# EasyEDA Pro project ProProject_Avaota Pi A_2024-03-25.epro, board 点位 (continued)
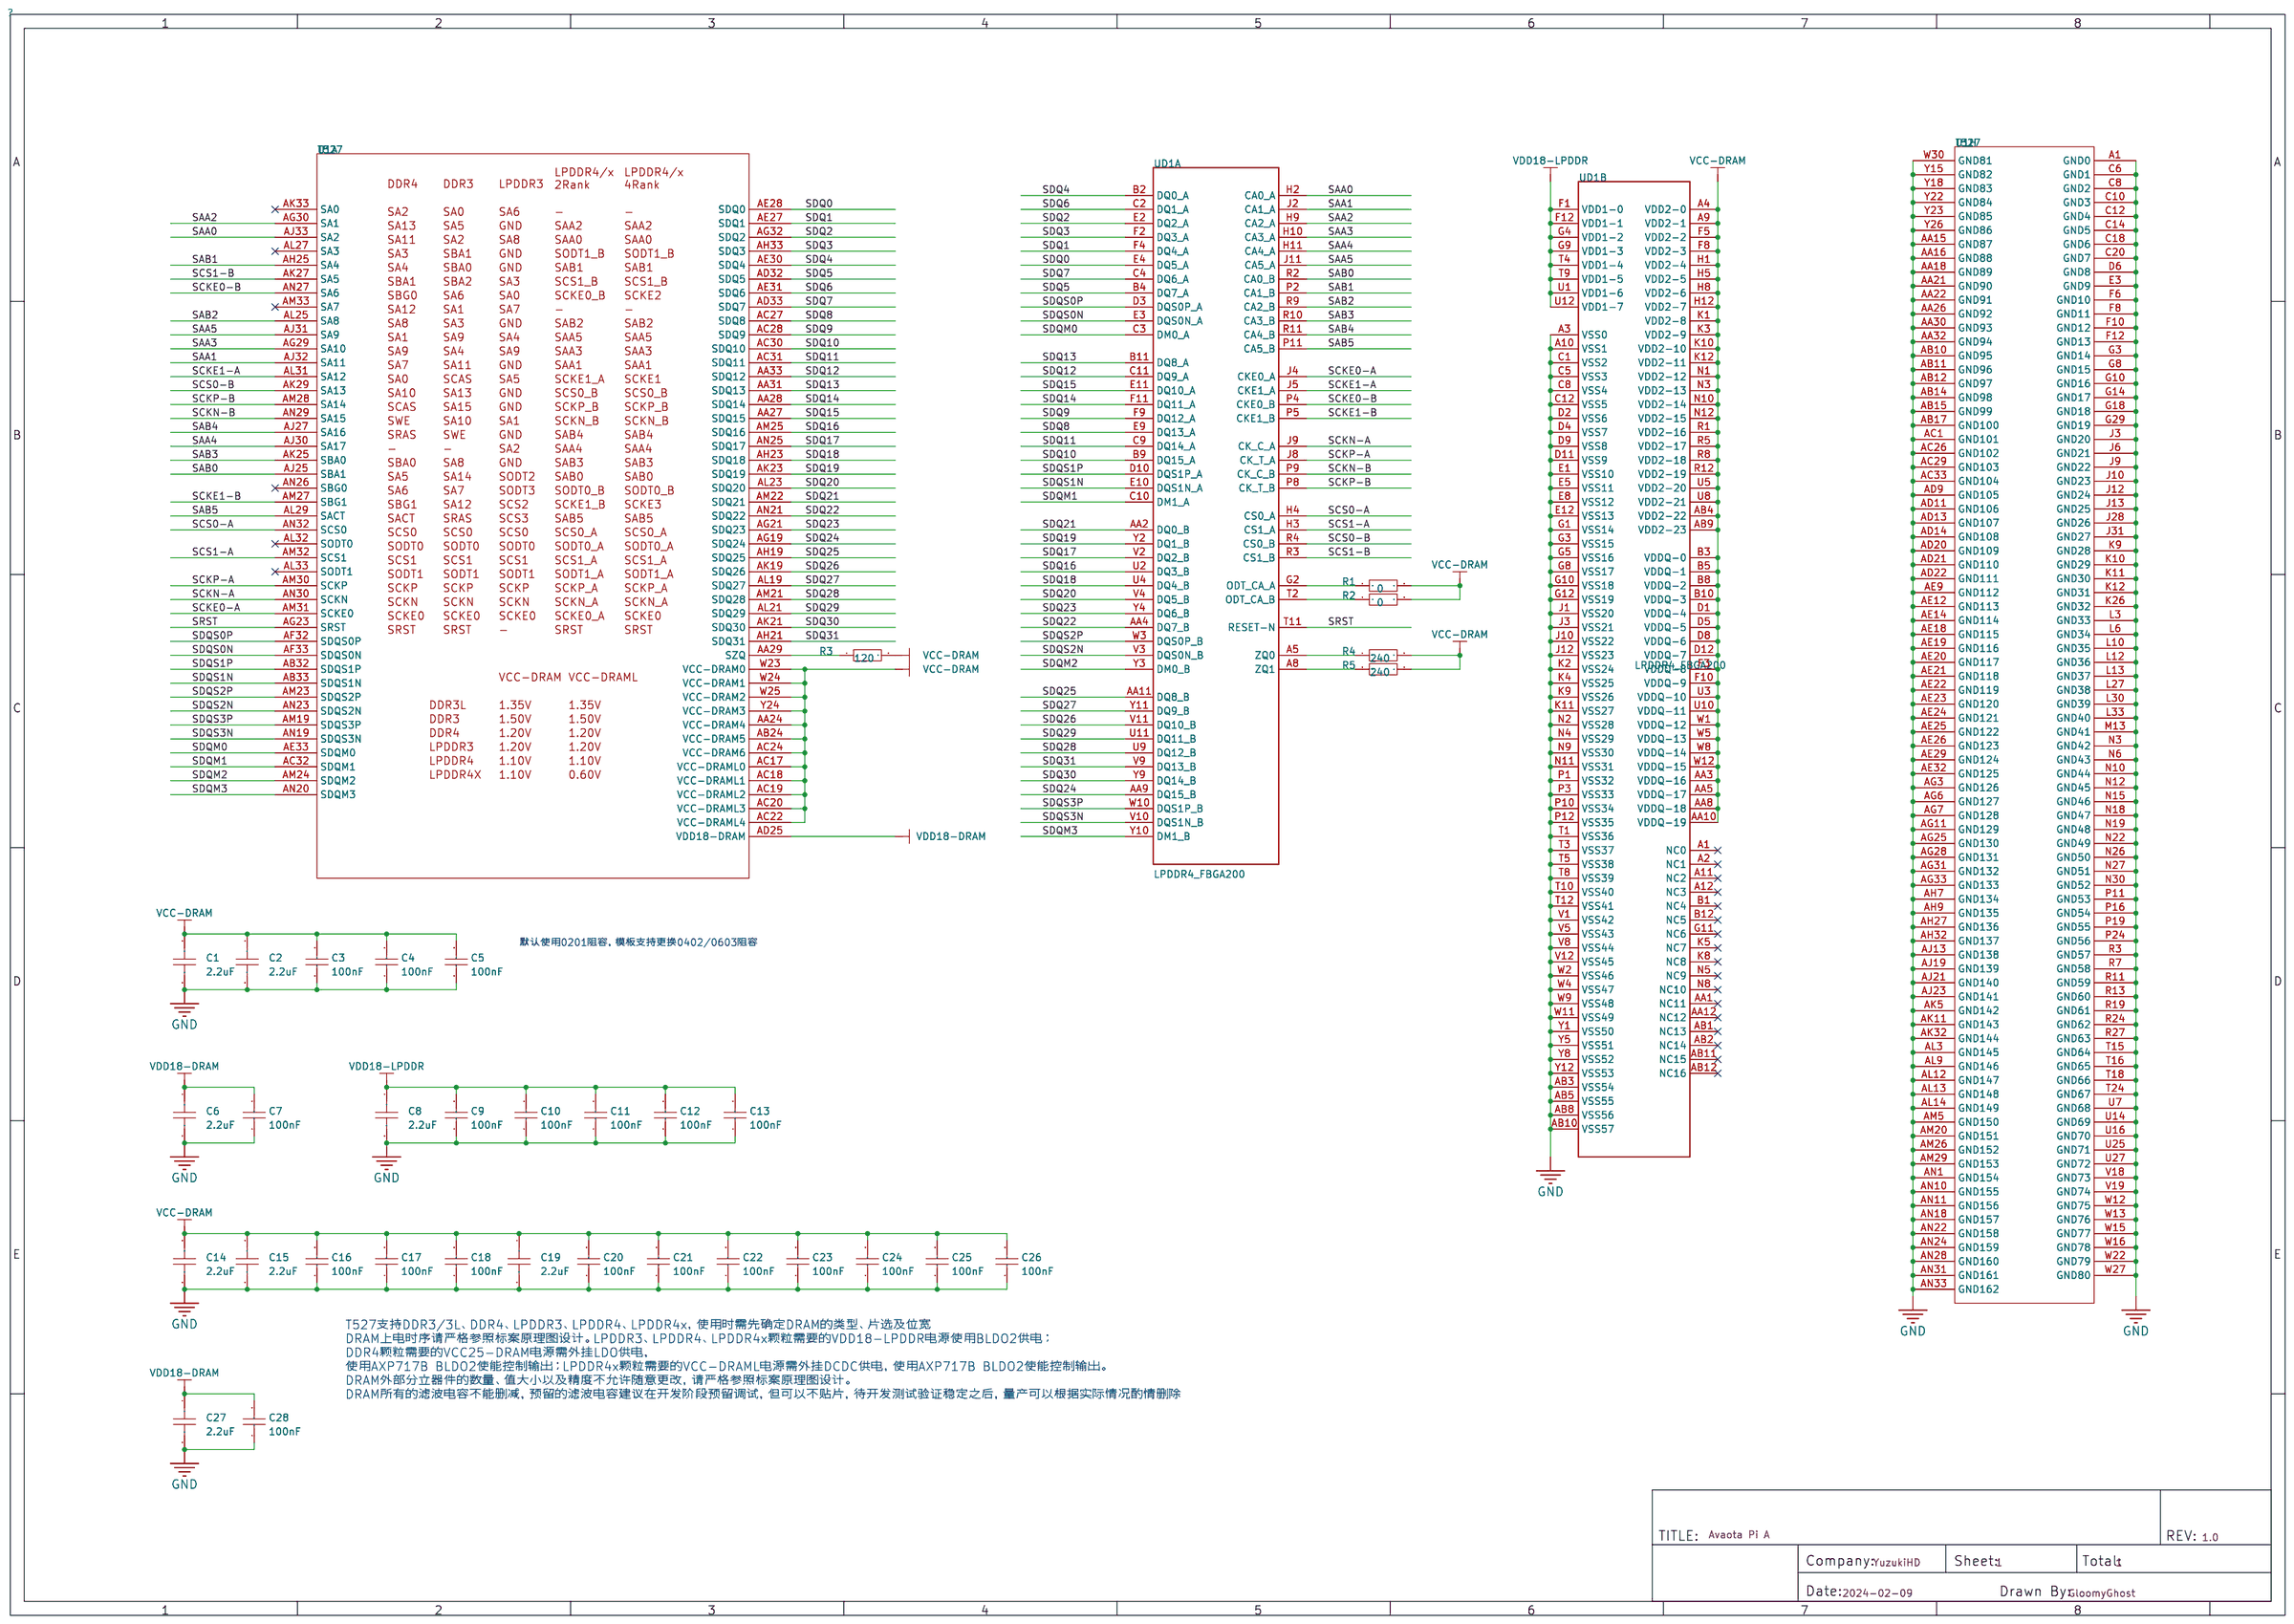
[diagram p0: schematic sheet]
## Routing (per net, layer and track width the routed paths; a pad name or vN(x,y) marks a point on that pad's centre or on a via; arc(x,y) is an arc through that point) (continued)
  vias: v2(40.18,43.31) v2(42.64,46.08) v2(58.43,47.14) v3(11.4,57.96) v3(11.38,57.28) v3(11.86,57.28) v3(11.86,56.72) v3(11.89,57.96) v3(12.37,57.25)
DCDC4: length 410.5
  Top Layer w0.102: R106.1 R110.2 79.65,23.99 ; R99.2 R102.2 79.67,23.98 79.65,23.99 ; v3(78.59,23.98) 79.13,23.98 C271.1 79.65,23.99 ; U13.40 81.88,20.49 81.79,20.4 81.79,19.89 81.08,19.18 v3(80.82,19.18) 80.39,18.75 C269.1
  Top Layer w0.127: C262.1 62.05,18.77 v1(63.37,20.09) 63.37,20.45 63.55,20.63 U12.40 ; R92.2 61.06,24.57 60.98,24.57 ; R92.2 61.07,24.66 ; R92.2 R84.2 R81.2 ; 60.98,24.57 61.07,24.66 ; 60.98,24.57 C263.1 ; 61.07,24.66 R88.1 ; R90.1 71.41,20.98 C264.1 69.98,20.45 69.8,20.63 U12.11
  Top Layer w0.152: U13.11 88.28,20.49 v3(88.49,20.27) 88.99,20.27 arc(89.14,20.41) 89.31,20.55 arc(89.44,20.68) R108.1 ; v3(62.94,52.58) U14.P9
  Top Layer w0.203: C250.1 v3(65.13,25.98) 65.2,25.91 U12.29 ; 83.36,24.79 83.36,25.61 83.19,25.78 83.19,26.51 C258.1
  Top Layer w0.254: v3(94.06,17.63) 94.1,17.59 R124.2 R125.2 ; v1(1.96,36.88) 2.05,36.78 v1(4.42,36.78) ; U14.K19 64.94,46.67 v1(64.95,46.66) ; v1(1.93,36.32) 4.37,36.32 v1(4.42,36.28) ; v1(91.41,38.36) v1(91.08,38.68) 91.08,39.19 90.55,39.73 89.48,39.73 88.68,40.53 88.68,44.36 89.26,44.93 v1(89.99,44.93) ; U14.L17 64.94,48.15 U14.J18 U14.J19 65.44,46.67 v1(65.46,46.66) ; v3(60.02,24.56) 60.47,24.56 C263.1 ; v3(4.78,56.72) R14.1 ; R61.1 50.19,25.31 v1(50.19,26.19)
  Top Layer w0.508: U9.9 v1(16.84,57.83)
  VCC w0.152: 3.25,56.79 4.7,56.79 v3(4.78,56.72)
  VCC w0.254: v3(94.06,17.63) 92.66,17.63 90.27,20.02 90.02,20.27 v3(88.49,20.27) ; v3(83.25,25.72) 82.37,24.84 82.22,24.84 ; 50.18,23.44 50.19,23.45 v1(50.19,26.19) ; v1(70.21,20.42) 70.1,20.32 64.47,20.32 64.03,20.75
  VCC w0.381: v1(65.46,46.66) 65.43,46.63 65.43,41.53 65.02,41.12 ; v3(62.94,52.58) 62.94,52.2 63.09,52.04 64.24,52.04 v1(64.39,52.2) 64.95,51.64 v1(64.95,46.66) 64.95,44.15 v3(64.44,43.65) 64.44,43.64 64.44,41.45 64.67,41.22
  VCC w0.508: 15.01,68.71 15.88,67.84 15.88,58.79 v1(16.84,57.83) ; 52.39,18.73 52.83,19.17 52.83,23.34 52.73,23.44
  VCC w0.762: v1(63.37,20.09) 64.03,20.75 64.03,23.62 63.03,24.62 62.69,24.62 ; 82.32,20.68 v3(80.82,19.18) ; 82.32,20.68 82.91,20.09 88.5,20.09 ; 82.32,20.68 82.32,23.88 81.59,24.61 ; 62.69,24.62 64.05,25.98 v3(65.13,25.98) 76.66,25.98 78.59,24.05 v3(78.59,23.98) ; 62.69,24.62 62.63,24.56 v3(60.02,24.56) ; 70.38,26.21 70.76,26.59 70.76,28.55 65.73,33.59 65.73,40.12 64.74,41.1 ; 78.13,24.71 82.24,24.71 ; 87.71,20.02 90.75,20.02 92.53,21.79 92.53,37.24 v1(91.41,38.36) v1(91.08,38.68)
  VCC w1.27: 28.22,70.69 26.14,68.61 5.82,68.61 ; 3.25,53.14 3.25,66.04 5.82,68.61 ; v3(60.02,24.56) 58.9,23.44 48.74,23.44 46.38,25.81 40.11,25.81 38.53,24.23 32.33,24.23 26.19,18.09 6.07,18.09 2.01,22.15 2.01,51.56 3.46,53.01 v3(3.56,53.01) ; 5.82,68.61 7.9,70.69
  内层4 w0.381: v1(57.44,48.65) 58.62,48.65 58.93,48.34 58.93,46.18 59.46,45.64 60.68,45.64 61.24,45.09 62.84,45.09 64.41,46.66 v1(64.95,46.66)
  Bottom Layer w0.254: C223.2 53.19,21.19 52.73,20.73 ; U11.5 C204.2 98.59,16.93 98.32,16.66 95.02,16.66 ; RJ2.14 90.84,2.69 ; 90.84,2.69 91.54,2.69 95.35,6.5 95.35,16.33 95.02,16.66 ; 90.84,2.69 80.05,2.69 78.84,1.48 78.55,1.78 74.06,1.78 RJ1.14 72.29,3 62.07,3 RJ1.11 ; 65.31,46.89 65.46,46.75 v1(65.46,46.66) C176.2 ; v3(64.44,43.65) 64.44,43.64 C169.2 ; 93.34,29.85 93.46,29.96 FPC2.4 ; 93.34,29.85 v1(92.74,29.85) ; 93.34,29.85 92.96,29.46 ; FPC1.3 5.51,36.78 v1(4.42,36.78) ; FPC2.2 92.91,28.96 92.68,29.18 92.96,29.46 ; FPC1.4 v1(4.42,36.28) ; 52.73,20.73 52.73,19.07 52.39,18.73 ; 52.73,20.73 52.4,21.05 C224.2 ; C177.2 57.89,48.65 v1(57.44,48.65) ; 95.02,16.66 v3(94.06,17.63) ; v1(89.99,44.93) 90.07,44.93 90.45,45.31 90.45,48.11 88.72,49.84 U16.5 89.19,50.53 C276.1 ; FPC2.3 92.96,29.46 ; v1(64.39,52.2) 64.44,52.25 C170.2 ; C175.2 64.92,46.63 v1(64.95,46.66) 64.93,46.68 C167.2
  vias: v1(92.74,29.24) v3(3.56,53.54) v3(4.09,53.54) v3(4.11,53.04) v3(4.6,53.52)
DCIN-5V: length 9.1
  Top Layer w0.254: D3.1 7.74,43.18 9.77,41.15 13.08,41.15 14.22,40.01 R3.2
DCIN-12V: length 7.5
  Top Layer w0.254: 11.99,30.28 U3.2 12.12,30.63 12.52,30.63 12.65,30.51 12.65,29.79 12.9,29.54 12.9,29.36 13.33,28.93 14.33,28.93 14.58,28.68 14.58,27.91 14.81,27.69 16.03,27.69 16.19,27.85 R4.2
DCXO-XIN: length 5.7
  Top Layer w0.102: U14.AM13 53.64,50.44 53.21,50.44 53.11,50.34 51.09,50.34 C99.2 50.44,50.36 49.56,50.36 49.02,50.9 X1.1
DCXO-XOUT: length 3.7
  Top Layer w0.102: U14.AN13 51.12,50.15 C98.2 50.35,49.8 X1.3
DDR-PARA-SEL-ADC1: length 4.3
  Top Layer w0.076: 60.44,55.64 60.44,55.79 60.69,56.04 60.69,56.23 60.55,56.42 60.36,56.46 60.18,56.9 60.09,57.34
  Top Layer w0.102: 60.1,57.35 60.1,58.5 59.79,58.8 R31.1 R34.2
DDR-PARA-SEL-ADC2: length 6.2
  Top Layer w0.076: 60.44,55.14 60.19,55.39 60.18,55.85 59.82,56.37 59.64,57.21 59.64,57.21
  Top Layer w0.102: R32.1 R35.2 57.9,58.55 58.55,58.55 58.8,58.29 59.41,58.29 59.59,58.12 59.59,57.26 59.64,57.21 59.64,57.2
DSP-UART-RX: length 19.9
  Bottom Layer w0.102: H1.40 56.16,73.1 54.91,71.86 54.91,69.95 54.15,69.19 54.15,61.6 52.27,59.72 52.27,58.22 52.4,58.09 52.4,57.34 52.92,56.82 53.26,56.82 53.49,56.59 53.49,55.73 v1(53.44,55.68)
DSP-UART-TX: length 17.5
  Top Layer w0.102: v1(51.94,57.76) 51.94,57.07 52.65,56.36 52.65,55.42 52.93,55.15 U14.AN3
  Bottom Layer w0.102: 53.87,64.66 53.87,70.43 53.62,70.69 ; 53.87,64.66 53.87,64.74 ; 53.87,64.66 53.87,61.77 51.94,59.84 v1(51.94,57.76)
EDP-AUXN: length 41.7
  Top Layer w0.076: 68.44,40.14 68.49,40.1 68.49,39.94 69.6,38.83 69.6,38.58 70.05,38.13 70.05,38.1
  Top Layer w0.127: 70.05,38.1 73.25,34.9 73.25,34.4 74.24,33.41 74.24,30.96 72.87,29.59 62.64,29.59 59.14,26.09 v3(58.93,26.09) ; v3(49.66,25.82) 49.56,25.72 49.56,25.44 C199.1
  内层2 w0.127: v3(49.66,25.82) 49.45,25.62 49.45,25.4 49.58,25.27 49.89,25.27 50.02,25.4 50.02,25.68 50.15,25.81 50.27,25.81 50.4,25.68 50.4,25.4 50.53,25.27 50.66,25.27 50.78,25.4 50.78,25.68 50.91,25.81 51.04,25.81 51.16,25.68 51.16,25.4 51.29,25.27 52.04,25.27 52.29,25.03 58.08,25.03 58.93,25.88 v3(58.93,26.09)
EDP-AUXP: length 41.5
  Top Layer w0.076: 68.44,40.64 68.69,40.39 68.69,40.04 68.68,40.03 68.68,40 69.82,38.85 69.82,38.65 70.22,38.26
  Top Layer w0.127: 70.22,38.26 73.48,34.99 73.48,34.49 74.47,33.5 74.47,30.87 72.99,29.39 62.76,29.39 59.26,25.88 v3(59.26,25.68) ; C198.1 49.23,25.44 49.23,25.72 v3(49.12,25.82)
  内层2 w0.127: v3(59.26,25.68) 59.23,25.71 59.08,25.71 58.17,24.8 52.19,24.8 52,24.99 49.51,24.99 49.22,25.28 49.22,25.72 v3(49.12,25.82)
EDP-HPD: length 41.8
  Top Layer w0.127: v3(67.93,42.15) U14.C29 ; v3(51.1,26.24) 51.09,26.23 51.09,25.32 ; 51.09,25.32 50.95,25.32 50.64,25.01 D12.4 v3(50.64,22.2) ; 51.09,25.32 R60.2
  内层2 w0.127: v3(67.93,42.15) 69.61,42.15 70.51,41.25 70.51,38.35 66.85,34.7 66.85,33.4 66.32,32.87 57.73,32.87 v3(51.1,26.24)
  Bottom Layer w0.127: v3(50.64,22.2) 50.5,22.06 50.5,19.46 50.9,19.05 51.1,19.05 51.56,18.59 51.56,17.93 52.06,17.43 52.39,17.43
EDP-TX0N: length 39.1
  Top Layer w0.076: 68.94,42.14 69.19,41.89 70.43,41.89 71.21,41.11
  Top Layer w0.102: C196.1 52.4,25.46 52.4,25.68 v3(52.53,25.81)
  Top Layer w0.127: v3(75.82,37.39) 75.66,37.39 74.72,38.33 74,38.33 71.21,41.11
  内层2 w0.127: v3(75.82,37.39) 75.66,37.39 75.26,37.8 71.4,37.8 67.72,34.11 67.72,32.79 67.03,32.11 58.19,32.11 52.38,26.29 52.38,26.22 52.53,26.07 v3(52.53,25.81)
EDP-TX0P: length 39.1
  Top Layer w0.076: 71.37,41.28 70.58,42.07 69.51,42.07 69.44,42.14
  Top Layer w0.102: C197.1 52.12,25.45 52.12,25.68 v3(51.99,25.81)
  Top Layer w0.127: 71.37,41.28 74.09,38.56 74.9,38.56 75.56,37.9 v3(75.84,37.9)
  内层2 w0.127: v3(51.99,25.81) 51.99,26.07 52.15,26.22 52.15,26.38 52.28,26.52 52.28,26.7 52.46,26.88 52.64,26.88 52.82,27.06 52.82,27.24 53,27.42 53.18,27.42 53.36,27.6 53.36,27.78 53.54,27.95 53.72,27.95 53.9,28.13 53.9,28.31 54.08,28.49 54.26,28.49 58.1,32.33 66.93,32.33 67.49,32.89 67.49,34.21 71.3,38.02 75.44,38.02 75.56,37.9 v3(75.84,37.9)
EDP-TX1N: length 37.7
  Top Layer w0.076: 68.94,41.64 69.18,41.4 70.1,41.4 70.33,41.17 70.33,41.15
  Top Layer w0.127: 70.33,41.15 71.68,39.8 71.68,39.47 73.71,37.44 74.25,37.44 75.36,36.33 v3(75.36,36.12) ; C194.1 53.85,25.48 53.85,25.71 v3(54,25.86) 53.91,25.86
  内层2 w0.127: v3(75.36,36.12) 75.36,36.35 74.75,36.96 71.7,36.96 68.55,33.81 68.55,32.23 67.51,31.19 58.62,31.19 53.86,26.43 53.86,26.26 54,26.12 v3(54,25.86)
EDP-TX1P: length 37.6
  Top Layer w0.076: U14.A30 69.48,41.61 70.21,41.61 70.51,41.3
  Top Layer w0.127: C195.1 53.62,25.45 53.62,25.73 v3(53.49,25.86) ; v3(75.72,36.51) 75.51,36.51 74.35,37.67 73.81,37.67 71.91,39.57 71.91,39.9 70.51,41.3
  内层2 w0.127: v3(75.72,36.51) 75.52,36.51 74.85,37.19 71.61,37.19 68.33,33.9 68.33,32.33 67.41,31.42 58.53,31.42 53.63,26.52 53.63,26.26 53.49,26.12 v3(53.49,25.86)
EDP-TX2N: length 35.8
  Top Layer w0.076: 68.94,41.14 69.07,41.14 69.32,40.89 69.9,40.89 70.76,40.03 70.76,40.01
  Top Layer w0.127: v3(74.96,34.95) 74.96,35.12 70.99,39.08 70.99,39.78 70.76,40.01 ; C192.1 55.25,25.43 55.25,25.71 v3(55.37,25.83)
  内层2 w0.127: v3(74.96,34.95) 74.96,35.1 73.91,36.14 71.95,36.14 69.37,33.56 69.37,31.7 67.97,30.3 59.11,30.3 55.21,26.41 55.21,26.24 55.37,26.08 v3(55.37,25.83)
EDP-TX2P: length 35.8
  Top Layer w0.076: 69.44,41.14 69.51,41.07 70.02,41.07 70.93,40.17
  Top Layer w0.127: v3(75.26,35.38) 75.02,35.38 71.22,39.18 71.22,39.87 70.93,40.17 ; C193.1 54.94,25.43 54.94,25.73 v3(54.81,25.86)
  内层2 w0.127: v3(75.26,35.38) 75,35.38 74.01,36.37 71.86,36.37 69.14,33.66 69.14,31.83 67.84,30.53 59.01,30.53 54.98,26.5 54.98,26.24 54.81,26.07 v3(54.81,25.86)
EDP-TX3N: length 35.5
  Top Layer w0.076: 68.94,40.14 69.01,40.07 69.01,39.97 69.33,39.65 69.58,39.65 69.7,39.52 69.88,39.52 69.98,39.62 70.31,39.62 70.41,39.52 70.41,39.4
  Top Layer w0.127: v3(75.1,32.34) 75.1,32.57 74.81,32.87 74.81,33.79 73.91,34.68 73.91,35.1 70.41,38.61 70.41,39.4 ; v3(56.87,25.83) 56.74,25.71 56.74,25.43 C190.1
  内层2 w0.127: v3(56.87,25.83) 56.87,26.05 56.71,26.21 56.71,26.58 59.56,29.44 72.75,29.44 74.55,31.24 74.55,31.46 74.68,31.59 75.11,31.59 75.23,31.71 75.23,31.84 75.11,31.97 74.68,31.97 74.55,32.1 74.55,32.46 74.83,32.74 75.03,32.74 75.16,32.61 75.16,32.39 v3(75.1,32.34)
EDP-TX3P: length 35.3
  Top Layer w0.076: 70.64,39.4 70.64,39.55 70.59,39.6 70.59,39.6 70.36,39.83 69.4,39.83 69.19,40.04 69.19,40.25 69.19,40.25 69.19,40.39 68.94,40.64
  Top Layer w0.127: C191.1 56.44,25.43 56.44,25.73 v3(56.34,25.83) ; v3(75.52,32.71) 75.28,32.71 75.04,32.96 75.04,33.88 74.14,34.77 74.14,35.2 70.64,38.7 70.64,39.4
  内层2 w0.127: v3(75.52,32.71) 75.39,32.71 75.11,32.99 74.73,32.99 74.29,32.56 74.29,31.31 72.65,29.67 59.47,29.67 56.48,26.68 56.48,26.21 56.34,26.07 v3(56.34,25.83)
EMMC-VDDI: length 3.1
  Top Layer w0.102: v3(42.24,36.5) 41.91,36.17 41.91,35.63 U8.C2
  Bottom Layer w0.254: C232.2 C231.1 ; C232.2 42.47,36.73 v3(42.24,36.5) ; C232.2 C233.2
FEL: length 88.8
  Top Layer w0.127: U14.F16 v3(66.94,49.15)
  内层2 w0.152: v1(0.84,51.69) 2.01,52.86 2.01,58.22 4.27,60.48 14.91,60.48 16.15,59.23 v1(19.08,59.23)
  VCC w0.152: v1(19.08,59.23) 20.19,59.23 22.35,57.07 24.77,57.07 30.63,62.94 47.45,62.94 49.89,60.5 58.42,60.5 58.72,60.81 59.64,60.81 60.22,60.22 60.22,57.38 61.7,55.91 63.6,55.91 64.41,55.09 64.41,52.98 65.48,51.92 65.48,50.34 66.67,49.15 v3(66.94,49.15)
  Bottom Layer w0.152: R22.2 2.52,51.7 C96.2 0.85,51.7 v1(0.84,51.69)
GM0_DVDD10: length 28.4
  Top Layer w0.127: 67.6,19.93 v3(67.6,19.18) 67.6,18.72 C266.1 ; 61.58,19.96 61.68,19.86 62.08,19.86 62.66,20.45 62.66,21.01 v3(62.86,21.21) 63.08,21.43 U12.38 ; C267.1 v3(65.58,19.15) 65.58,19.91 U12.3 ; U12.21 68.4,25.32 69.8,26.72 v3(69.8,26.73)
  Bottom Layer w0.584: v3(69.8,26.73) 69.8,26.47 68.22,24.89 65.1,24.89 64.16,23.95 ; 64.11,21.67 63.64,21.21 v3(62.86,21.21) ; 64.11,21.67 64.11,23.85 61.87,26.09 v3(61.87,26.39) v3(61.87,26.95) ; 64.11,21.67 64.11,21.41 65.58,19.94 ; v3(67.6,19.18) 66.84,19.94 65.58,19.94 ; 65.58,19.94 v3(65.58,19.15)
GM0_INTB: length 2.9
  Top Layer w0.102: U12.31 63.5,24.23 62.99,24.74 62.66,24.74 62.31,25.1 61.58,25.1 61.56,25.12
GM0_LED0: length 2.8
  Top Layer w0.102: U12.32 63.37,23.83 62.81,24.38 62.34,24.38 62.2,24.52 62.17,24.56 61.56,24.56
GM0_LED1: length 24.1
  Top Layer w0.102: 62.17,24 R87.1 ; 62.17,24 61.56,24 ; 62.17,24 62.56,24 v1(62.84,23.72) 63.13,23.43 U12.33
  Top Layer w0.152: R94.2 v1(57.99,6.2) R80.2
  内层4 w0.152: v1(62.84,23.72) 62.84,23.42 62.38,22.96 61.14,22.96 57.48,19.3 57.48,6.7 v1(57.99,6.2)
GM0_LED2: length 23.5
  Top Layer w0.127: U12.34 62.7,23.03 v1(62.31,23.42) 61.58,23.42 61.56,23.39
  Top Layer w0.152: R79.1 v1(57.4,6.19) R96.2
  内层4 w0.152: v1(62.31,23.42) 62.15,23.27 60.91,23.27 57.12,19.48 57.12,6.47 v1(57.4,6.19)
GM0_MDIN0: length 8.5
  Top Layer w0.127: RJ1.P3 64,14.47 63.81,14.28 63.22,14.28 62.81,14.68 62.81,16.31 65.11,18.61 65.11,19.38 65.2,19.47 U12.2
GM0_MDIN1: length 14.3
  Top Layer w0.127: RJ1.P7 69.08,12.57 68.25,11.74 67.21,11.74 66.55,12.4 66.55,13.49 65.41,14.63 65.41,16.34 66.31,17.25 66.31,19.38 66.4,19.47 U12.5
GM0_MDIN2: length 7.8
  Top Layer w0.127: U12.7 67.2,19.47 67.11,19.38 67.11,17.06 67.86,16.32 67.86,14.58 67.37,14.09 67.37,13.15 RJ1.P6
GM0_MDIN3: length 8.4
  Top Layer w0.127: RJ1.P9 71.62,14.4 71.5,14.28 70.97,14.28 70.38,14.86 70.38,17.25 68.31,19.32 68.31,19.38 68.4,19.47 U12.10
GM0_MDIP0: length 8.5
  Top Layer w0.127: RJ1.P2 63.06,13.23 63.06,14.11 62.59,14.59 62.59,16.41 64.88,18.71 64.88,19.38 64.8,19.47 U12.1
GM0_MDIP1: length 14.3
  Top Layer w0.127: RJ1.P4 65.23,12.75 65.23,10.9 65.63,10.49 66.57,10.49 67.06,10.97 67.06,11.53 66.32,12.27 66.32,13.39 65.18,14.54 65.18,16.43 66.08,17.34 66.08,19.38 66,19.47 U12.4
GM0_MDIP2: length 7.8
  Top Layer w0.127: RJ1.P5 66.73,15.16 66.73,14.38 66.85,14.25 67.21,14.25 67.63,14.67 67.63,16.22 66.88,16.97 66.88,19.38 66.8,19.47 U12.6
GM0_MDIP3: length 8.5
  Top Layer w0.127: U12.9 68,19.47 68.08,19.38 68.08,19.22 70.15,17.15 70.15,14.76 70.82,14.1 70.82,13.74 70.25,13.18 RJ1.P8
GM0_RSET: length 3.5
  Top Layer w0.127: U12.39 63.23,21.03 63.02,20.82 63.02,20.32 62.26,19.56 61.76,19.56 R85.2
GM0_XTAL_IN: length 4.2
  Top Layer w0.127: X3.1 60.48,22.25 61.06,21.67 61.8,21.67 C252.2 63.3,22.07 63.45,22.23 U12.36
GM0_XTAL_OUT: length 3
  Top Layer w0.127: X3.3 61.82,21.21 C251.2 62.7,21.7 63.46,21.7 63.59,21.83 U12.37
GM1_DVDD10: length 26.2
  Top Layer w0.102: C273.1 80.23,19.91 80.85,19.91 81.15,20.22 81.15,20.7 81.74,21.29 U13.38
  Top Layer w0.127: C272.1 v3(85.78,19.11) 85.78,19.77 U13.8 ; C275.2 83.77,18.72 v3(83.77,19.13) 83.77,19.78 U13.3
  Top Layer w0.152: 87.68,26.56 86.56,25.43 86.56,24.79
  Bottom Layer w0.254: v3(86.69,25.5) arc(86.25,25.08) 85.8,24.66
  Bottom Layer w0.635: v3(85.78,19.11) 84.8,20.09 82.8,20.09 ; v3(80.06,26.62) v3(80.06,26.15) 82.45,23.76 ; 82.45,23.76 82.45,20.45 ; 82.45,23.76 83.35,24.66 85.8,24.66 ; 82.45,20.45 82.8,20.09 ; 82.45,20.45 81.79,20.45 v3(81.31,20.93) ; 82.8,20.09 v3(83.77,19.13)
GM1_DVDDRG: length 382.5
  Top Layer w0.102: R101.1 89.74,21.91 v3(89.74,21.97)
  Top Layer w0.127: v3(71.96,21.9) 71.91,21.84 R83.1 ; R47.1 34.66,18.99 30.81,22.83 v1(28.96,22.83)
  Top Layer w0.152: v3(67.31,27.69) 67.31,27.27 67.34,27.24
  Top Layer w0.178: R109.2 87.07,27.33 87.38,27.64 88.01,27.64 88.34,27.31 88.34,25.88 88.67,25.55 90.09,25.55 90.53,25.12 90.53,24.28 89.74,23.5 v3(89.74,21.97) ; v3(83.85,28.58) 84.28,28.58 85.37,27.48 R107.2
  Top Layer w0.203: 83.77,26.47 83.67,26.37 83.67,25.93 v3(83.76,25.84) 83.76,24.79 ; U4.26 12.04,54.43 12.67,55.07 v1(12.92,55.07) ; U12.28 65.6,25.92 65.63,25.96 v3(65.63,26.71)
  Top Layer w0.254: 40.58,33.3 U8.J10 U8.K9 ; 40.58,33.3 40.58,33.48 U8.F5 39.6,33.32 v1(39.6,33.17) ; 40.58,33.3 U8.E6 ; 69.19,27.24 69.19,27.46 69.01,27.64
  VCC w0.254: v1(56.73,65.81) 57.8,66.88 62.56,66.88 63.7,68.02 67.13,68.02 68.71,69.6 76.2,69.6 78.54,71.93 91.69,71.93 95.17,68.45 97.05,68.45 97.54,67.97 97.54,64.95 97.16,64.57 97.16,52.69 v3(96.11,51.65)
  VCC w0.381: v3(58.44,52.15) 57.94,52.65 57.94,53.62 57.4,54.15 57.4,55.56 56.93,56.03 54.18,56.03 53.34,56.87 52.12,56.87 47.52,61.47 29.87,61.47 24.23,55.83 14,55.83 13.23,55.07 v1(12.92,55.07)
  VCC w0.508: v3(96.11,51.65) 95.68,51.22 95.68,44.76 90.2,39.27 90.2,38.18 91.54,36.83 91.54,29.57 90.55,28.58 v3(83.85,28.58) 83.44,28.17 v1(82.25,28.17) ; 41.15,27.36 39.57,27.36 37.95,25.73 31.85,25.73 v1(28.96,22.83) 25.6,19.48 6.78,19.48 3.1,23.17 3.1,50.98 5.36,53.24 5.36,54.48 7.05,56.18 11.8,56.18 v1(12.92,55.07)
  VCC w0.635: v1(39.6,33.17) 39.6,28.91 41.15,27.36 41.66,27.86 59.41,27.86 ; 59.41,27.86 59.59,27.86 ; 59.41,27.86 63.65,27.94 64.13,27.46 67.08,27.46 v3(67.31,27.69)
  Inner5 w0.457: 60.35,51 60.12,51.23 59.36,51.23 v3(58.44,52.15) ; 60.45,50.98 61.29,50.14 62.31,50.14 62.46,49.99 63.07,49.99 63.96,49.1 v1(64.44,49.1)
  Bottom Layer w0.152: v1(39.6,33.17) 40,32.77 C229.2 C235.2 ; v1(95.72,46.76) C228.1 C234.1
  Bottom Layer w0.254: v1(39.6,33.17) 39.4,32.97 C230.2 ; R75.2 v1(56.73,65.81) 57.19,66.27 57.38,66.27 ; SIM1.4 98.56,58.81 96.88,57.12 96.88,56.01 96.11,55.25 v3(96.11,51.65) D20.1 ; 57.38,66.27 57.96,66.85 63.02,66.85 64.57,68.4 65.33,68.4 65.57,68.16 R73.2 65.57,67.4 66.78,66.19 R74.2 ; 57.38,66.27 57.49,66.27 ; 57.38,66.27 57.28,66.17 ; v1(64.44,49.1) 64.39,49.15 C173.2 C174.2 ; 65.61,27.23 65.63,27.2 v3(65.63,26.71) ; C102.2 58.44,52.15
  Bottom Layer w0.381: v3(83.76,25.84) 83.77,25.83 86,25.83 86.28,26.11 86.94,26.11 87.27,25.78 87.27,24.56 88.01,23.83 89.41,23.83 89.89,23.34 89.89,22.12 v3(89.74,21.97)
  Bottom Layer w0.635: 71.91,21.9 69.77,21.9 69.16,22.5 69.16,24.74 70.56,26.14 70.56,27.05 69.93,27.69 ; 69.93,27.69 76.94,27.69 77.42,28.17 v1(82.25,28.17) 83.44,28.17 v3(83.85,28.58) 86.77,28.58 87.88,27.46 87.88,26.39 87.32,25.83 ; 69.93,27.69 v1(69,27.69) v3(67.31,27.69) 66.04,27.69 65.66,27.31
GM1_INTB: length 2.3
  Top Layer w0.102: 82.26,24.09 81.68,24.09 81.23,24.54 R106.2
GM1_LED0: length 2.2
  Top Layer w0.102: R110.1 80.16,23.99 R105.2 81.22,23.99 81.52,23.69 U13.32
GM1_LED1: length 27.1
  Top Layer w0.102: 82.26,23.29 v1(81.41,23.29) 81.23,23.47 80.78,23.47 R105.1 80.72,23.48 R102.1
  Top Layer w0.152: v3(76.3,8.1) 76.94,7.47 76.94,6.63 76.65,6.34 R112.2 R98.2
  内层2 w0.152: v3(76.3,8.1) 75.95,7.75 74.68,7.75 73.43,8.99 73.43,10.36 74.32,11.25 75.72,11.25 76.71,12.24 76.71,18.47 80.77,22.53 80.95,22.53 81.41,22.99 v1(81.41,23.29)
GM1_LED2: length 25.4
  Top Layer w0.102: U13.34 81.28,22.89 81.13,23.04 v1(80.82,23.04) 80.2,23.04 R99.1
  Top Layer w0.152: v3(75.64,7.31) 75.54,7.21 75.54,6.5 75.7,6.34 R114.2 R97.1
  内层2 w0.152: v3(75.64,7.31) 75.54,7.42 74.52,7.42 73.15,8.79 73.15,10.54 74.24,11.63 75.56,11.63 76.35,12.42 76.35,18.57 v1(80.82,23.04)
GM1_MDIN0: length 8.7
  Top Layer w0.127: 82.27,15.33 82.45,15.14 82.45,14.38 82.27,14.2 81.64,14.2 81.1,14.73 81.1,16.44 83.27,18.61 83.27,19.24 83.36,19.33 U13.2
GM1_MDIN1: length 14.1
  Top Layer w0.127: U13.5 84.54,19.78 84.54,17.22 84.43,17.11 ; 84.43,17.11 83.7,16.38 83.7,14.68 84.85,13.53 84.85,12.44 85.51,11.78 86.55,11.78 86.98,12.21 86.98,14.96 RJ2.P7 ; 84.43,17.11 84.5,17.18
GM1_MDIN2: length 7.8
  Top Layer w0.127: U13.7 85.36,19.26 85.3,19.2 85.3,17.21 86.18,16.33 86.18,14.66 85.62,14.1 85.62,13.14 RJ2.P6
GM1_MDIN3: length 8.5
  Top Layer w0.127: 89.89,15.33 89.92,15.3 89.92,14.38 89.71,14.17 89.28,14.17 88.72,14.73 88.72,16.28 86.47,18.53 86.47,19.24 86.56,19.33 U13.10
GM1_MDIP0: length 8.5
  Top Layer w0.127: U13.1 82.96,19.33 83.04,19.24 83.04,18.7 80.87,16.54 80.87,14.64 81.56,13.95 81.56,13.44 80.91,12.79 RJ2.P2
GM1_MDIP1: length 14.1
  Top Layer w0.127: 83.53,12.8 83.47,12.85 ; RJ2.P4 83.44,11.03 83.93,10.54 84.87,10.54 85.35,11.02 85.35,11.58 84.62,12.31 84.62,13.44 83.47,14.58 83.47,16.48 84.31,17.32 84.31,19.18 84.16,19.33 U13.4
GM1_MDIP2: length 7.7
  Top Layer w0.127: U13.6 84.96,19.31 85.07,19.2 85.07,17.12 85.95,16.23 85.95,14.76 85.47,14.28 85.14,14.28 84.76,14.66 84.76,15.28 RJ2.P5
GM1_MDIP3: length 8.6
  Top Layer w0.127: RJ2.P8 88.58,12.79 89.18,13.39 89.18,13.95 88.49,14.64 88.49,16.19 86.24,18.44 86.24,19.24 86.16,19.33 U13.9
GM1_RSET: length 3.1
  Top Layer w0.102: R103.2 80.26,19.28 80.57,19.58 80.95,19.58 81.46,20.09 81.46,20.57 81.77,20.89 U13.39
GM1_XTAL_IN: length 3.9
  Top Layer w0.102: C259.2 80.92,21.64 81.23,21.64 81.68,22.09 82.26,22.09
  Top Layer w0.152: X4.1 79.71,21.46 80.39,21.46 C259.2
GM1_XTAL_OUT: length 2.8
  Top Layer w0.102: C257.2 80.75,21.18 80.92,21.36 81.38,21.36 81.71,21.69 U13.37
  Top Layer w0.152: C257.2 80.37,20.96 80.04,20.62
HBIAS: length 30.4
  Top Layer w0.203: U14.AL1 54.51,56.21 54.51,57.2 v3(54.71,57.4)
  内层2 w0.254: v3(63.96,69.55) 65.06,68.44 v3(71.78,68.44)
  GND2 w0.254: v3(54.71,57.4) 54.86,57.56 54.86,65.76 56.41,67.31 62.38,67.31 63.96,68.89 v3(63.96,69.55)
  Bottom Layer w0.127: R64.2 71.04,68.59 C237.2 v3(71.78,68.44)
HCEC: length 49.5
  Top Layer w0.102: U14.E28 v3(67.44,43.15)
  Top Layer w0.127: v3(40.36,23.11) 40.36,22.72 R48.1 38.95,22.7 38.56,22.3 D7.1
  Inner5 w0.127: v3(40.36,23.11) 41.28,24.03 42.11,24.03 42.54,24.46 43.64,24.46 43.97,24.79 44.4,24.79 47.45,27.84 59.31,27.84 60.27,28.8 64.59,28.8 68.12,32.33 68.12,33.99 70.54,36.4 70.54,42.14 70.28,42.39 69.8,42.39 69.42,42.77 67.82,42.77 v3(67.44,43.15)
HHPD: length 44.7
  Top Layer w0.102: v3(67.94,43.15) U14.D28
  Top Layer w0.127: R54.1 43.08,23.14 ; 43.08,23.14 44.27,24.33 v3(44.3,24.33) ; 43.08,23.14 C189.2
  Inner5 w0.127: v3(67.94,43.15) 69.55,43.15 69.93,42.77 70.43,42.77 70.92,42.29 70.92,36.17 68.5,33.76 68.5,32.06 64.85,28.4 60.48,28.4 59.51,27.43 47.7,27.43 44.6,24.33 v3(44.3,24.33)
HP-DET: length 25.9
  Top Layer w0.076: v3(55.07,57.05) 55.19,56.92 55.19,55.95 55.46,55.67
  Top Layer w0.152: v3(66.73,71.07) 68.06,72.41 CN2.3
  GND2 w0.152: v3(55.07,57.05) 55.27,57.25 55.27,65.56 56.67,66.95 62.61,66.95 v3(66.73,71.07)
HPOUTFB: length 42.5
  Top Layer w0.076: 53.62,57.1 53.62,56.64 53.94,56.33 53.94,56.14
  Top Layer w0.254: 53.62,57.1 53.59,57.13 v3(53.59,57.61) ; v3(62.64,69.29) 62.64,69.04 63.07,68.61 67.74,68.61 69.11,69.98 69.57,69.98 69.89,70.3 v3(69.89,70.5) 72.78,70.5 73.81,69.47 73.81,65.79 75.69,63.91 CN2.6
  GND2 w0.254: v3(53.59,57.61) 54,58.01 54,66.37 55.91,68.28 61.62,68.28 v3(62.64,69.29)
  Bottom Layer w0.254: R122.2 R66.2 v3(69.89,70.5) 70.1,70.71 70.45,70.71 C239.1
HPOUTL: length 36.6
  Top Layer w0.076: 54.15,56.64 54.15,56.43 54.19,56.39 54.19,55.9 54.44,55.64
  Top Layer w0.254: 54.15,56.64 54.15,57.53 v3(54.2,57.58) ; v3(63.35,69.04) 67.61,69.04 68.76,70.18 v3(68.76,70.59) 69.22,71.04 72.97,71.04 74.21,69.81 CN2.5
  GND2 w0.254: v3(63.35,69.04) 62.15,67.84 56.21,67.84 54.43,66.07 54.43,57.81 v3(54.2,57.58)
  Bottom Layer w0.254: C243.1 68.76,70.16 v3(68.76,70.59)
HPOUTR: length 32.7
  Top Layer w0.076: 53.93,55.68 53.93,55.73 53.7,55.97 53.7,56.29 53.31,56.67 53.31,56.87 53.19,57
  Top Layer w0.254: CN2.2 68.91,66.18 v3(68.91,66.9) 68.91,67.08 67.82,68.17 62.92,68.17 62.03,69.06 v3(61.67,69.06) ; v3(53.04,57.43) 53.09,57.38 53.09,57.1 53.19,57
  GND2 w0.254: v3(61.67,69.06) 61.37,68.76 55.65,68.76 53.57,66.68 53.57,58.27 53.04,57.73 v3(53.04,57.43)
  Bottom Layer w0.254: 68.14,68.68 68.91,67.91 v3(68.91,66.9)
HREXT: length 1
  Top Layer w0.102: v3(66.94,44.15) U14.F26
  Bottom Layer w0.254: v3(66.94,44.15) 66.91,44.12 R59.2
HS-MIC: length 8.3
  Top Layer w0.254: v3(74.5,72.19) 75.72,73.41 CN2.4
  Bottom Layer w0.127: 70.49,69.57 70.48,69.58
  Bottom Layer w0.254: R65.2 70.48,70.12 ; v3(74.5,72.19) 72.85,70.54 71.58,70.54 71.16,70.12 71.04,70.12 R64.1 ; 70.49,69.57 71.04,69.57
HSCL: length 48.3
  Top Layer w0.102: v3(67.94,44.15) U14.D26
  Top Layer w0.127: R50.1 v3(40.92,23.11)
  Inner5 w0.127: v3(40.92,23.11) 41.38,23.57 42.34,23.57 42.72,23.95 44.81,23.95 47.93,27.08 59.74,27.08 60.68,28.02 64.97,28.02 68.86,31.9 68.86,33.6 71.22,35.97 71.22,42.95 70.41,43.76 68.48,43.76 68.09,44.15 v3(67.94,44.15)
HSDA: length 49
  Top Layer w0.102: U14.E26 v3(67.44,44.15)
  Top Layer w0.127: R51.1 v3(42.01,23.17)
  Inner5 w0.127: v3(42.01,23.17) 42.82,23.17 43.26,23.6 44.91,23.6 48.01,26.7 59.92,26.7 60.88,27.66 65.23,27.66 69.24,31.67 69.24,33.43 71.55,35.74 71.55,43.13 70.53,44.15 68.5,44.15 68.1,44.55 67.84,44.55 v3(67.44,44.15)
HTX0N: length 73.1
  Top Layer w0.076: 68.44,43.14 68.45,43.14 68.58,43.01 arc(68.71,42.92) 68.86,42.89 69.52,42.89 arc(69.56,42.88) 69.59,42.86 69.78,42.67 71.27,42.67 arc(71.7,42.59) 72.06,42.34
  Top Layer w0.102: v3(45.03,22.17) 45.16,22.05 45.16,21.4 D6.2 D6.9 45.08,20.05 45.23,19.9 45.23,11.24 44.18,10.19 44.04,10.19 43.6,10.63 USB1.9 ; 72.06,42.32 72.41,41.97 arc(72.75,41.74) 73.15,41.66 74.14,41.63 arc(74.36,41.58) v3(74.52,41.43)
  内层4 w0.102: v3(74.52,41.43) 74.7,41.61 76.33,41.61 77.5,40.44 77.5,30.25 75.56,28.31 71.48,28.31 69.62,30.18 60.22,30.18 58.73,28.68 48.15,28.68 46.43,26.96 46.43,24.08 45.19,22.83 45.19,22.58 45.03,22.43 v3(45.03,22.17)
